# EasyEDA Pro project URADORRY-SUN.eprj, board Sub - ATmega32U4/Rev1.0
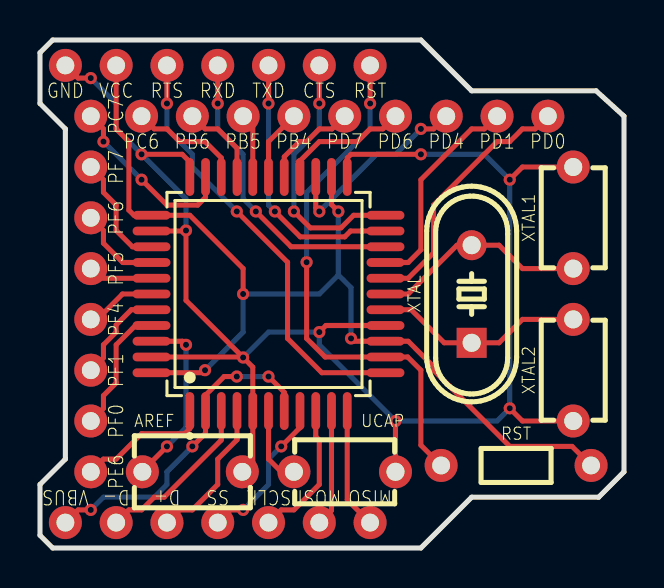
[diagram p2: board, top side]
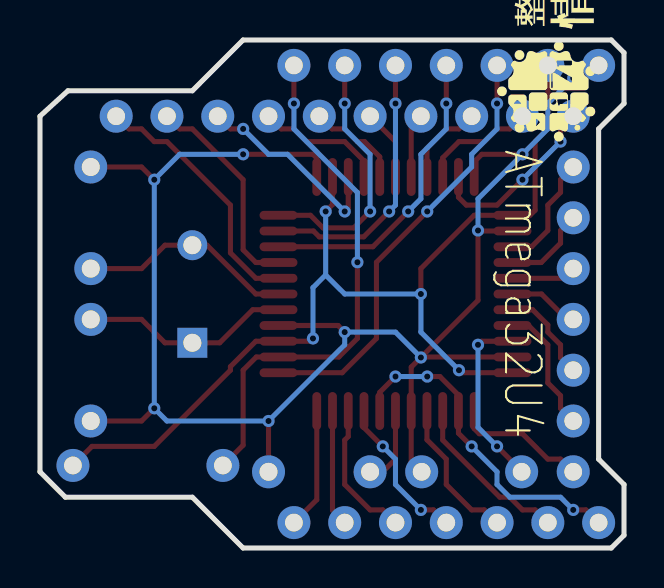
[diagram p3: board, bottom side, seen from below]

Outline 29.21 x 25.4 mm; copper layers: Top Layer, Bottom Layer. Coordinates in mm from the lower left corner of the outline.
Outline path: 0,24.77 0.64,25.4 19.05,25.4 21.59,22.86 27.81,22.86 29.21,21.59 29.21,3.81 27.94,2.54 21.59,2.54 19.05,0 0.64,0 0,0.64 0,3.17 1.27,4.45 1.27,20.95 0,22.23 0,24.77
Stack: Top Layer 0.035mm / Dielectric1 1.51mm FR4 er 4.5 / Bottom Layer 0.035mm

## Design rules (mm)
template: JLCPCB Capability(Two Layers Board)
spacing copperThickness1oz (default): track to track 0.102, other pairs 0.152 to 0.3
spacing copperThickness2oz: track to track 0.203, other pairs 0.152 to 0.3
track width copperThickness1oz (default): min 0.127, default 0.254, max 2.54
track width copperThickness2oz: min 0.203, default 0.254, max 2.54
differential pair differentialPair (default): width min 0.127, default 0.254, max 2.54; gap min 0.152, default 0.152
via viaSize (default): diameter min 0.5, default 0.61, max 10; hole min 0.3, default 0.305, max 6.3

## Placement (name value [footprint] x y rotation side)
AREF  100nF  [cap-th_l5.8-w3.6-p5.0-d0.6]  7.62 3.81 180 top
ATmega32U4  ATMEGA32U4-AU  [QFP-44_L10.0-W10.0-P0.80-LS13.2-BL]  11.43 12.7 0 top
NOREF  -  [Pad_e41]  6.35 24.13 0 top
NOREF#2  -  [Pad_e40]  13.97 24.13 0 top
NOREF#3  -  [Pad_e28]  1.27 24.13 0 top
NOREF#4  -  [Pad_e47]  7.62 21.59 0 top
NOREF#5  -  [Pad_e45]  2.54 21.59 0 top
NOREF#6  -  [Pad_e53]  2.54 19.05 0 top
NOREF#7  -  [Pad_e54]  2.54 16.51 0 top
NOREF#8  -  [Pad_e46]  5.08 21.59 0 top
NOREF#9  -  [Pad_e49]  12.7 21.59 0 top
NOREF#10  -  [Pad_e56]  2.54 8.89 0 top
NOREF#11  -  [Pad_e32]  6.35 1.27 0 top
NOREF#12  -  [Pad_e30]  1.27 1.27 0 top
NOREF#13  -  [Pad_e33]  8.89 1.27 0 top
NOREF#14  -  [Pad_e51]  17.78 21.59 0 top
NOREF#15  -  [Pad_e57]  2.54 11.43 0 top
NOREF#16  -  [Pad_e44]  25.4 21.59 0 top
NOREF#17  -  [Pad_e36]  16.51 1.27 0 top
NOREF#18  -  [Pad_e31]  3.81 1.27 0 top
NOREF#19  -  [Pad_e55]  2.54 13.97 0 top
NOREF#20  -  [Pad_e34]  11.43 1.27 0 top
NOREF#21  -  [Pad_e35]  13.97 1.27 0 top
NOREF#22  -  [Pad_e29]  3.81 24.13 0 top
NOREF#23  -  [Pad_e50]  15.24 21.59 0 top
NOREF#24  -  [Pad_e38]  11.43 24.13 0 top
NOREF#25  -  [Pad_e52]  20.32 21.59 0 top
NOREF#26  -  [Pad_e37]  16.51 24.13 0 top
NOREF#27  -  [Pad_e58]  2.54 6.35 0 top
NOREF#28  -  [Pad_e42]  2.54 3.81 0 top
NOREF#29  -  [Pad_e48]  10.16 21.59 0 top
NOREF#30  -  [Pad_e43]  22.86 21.59 0 top
NOREF#31  -  [Pad_e39]  8.89 24.13 0 top
RST  10kΩ  [res-th_bd1.7-l3.5-p7.50-d0.5]  23.81 4.13 180 top
UCAP  1uF  [cap-th_l5.0-w3.2-p5.08-d0.6]  15.24 3.81 180 top
XTAL  16MHz  [HC-49US_L11.5-W4.5-P4.88]  21.59 12.7 90 top
XTAL1  20pF  [cap-th_l5.0-w3.2-p5.08-d0.6]  26.67 16.51 270 top
XTAL2  20pF  [cap-th_l5.0-w3.2-p5.08-d0.6]  26.67 8.89 90 top

## Footprints (pads in the part's own frame, mm; a bottom-side part is the same pattern mirrored in y, then rotated)
cap-th_l5.0-w3.2-p5.08-d0.6
  round 1.651 hole 0.9x0.889: 1(-2.54,0) 2(2.54,0)
cap-th_l5.8-w3.6-p5.0-d0.6
  round 1.651 hole 0.889: 1(-2.5,0) 2(2.5,0)
HC-49US_L11.5-W4.5-P4.88
  rect 1.5x1.5 hole 0.9: 1(-2.44,0)
  round 1.5 hole 0.9: 2(2.44,0)
Pad_e28
  round 1.651 hole 0.889: 1(0,0)
Pad_e29
  round 1.651 hole 0.889: 1(0,0)
Pad_e30
  round 1.651 hole 0.889: 1(0,0)
Pad_e31
  round 1.651 hole 0.889: 1(0,0)
Pad_e32
  round 1.651 hole 0.889: 1(0,0)
Pad_e33
  round 1.651 hole 0.889: 1(0,0)
Pad_e34
  round 1.651 hole 0.889: 1(0,0)
Pad_e35
  round 1.651 hole 0.889: 1(0,0)
Pad_e36
  round 1.651 hole 0.889: 1(0,0)
Pad_e37
  round 1.651 hole 0.889: 1(0,0)
Pad_e38
  round 1.651 hole 0.889: 1(0,0)
Pad_e39
  round 1.651 hole 0.889: 1(0,0)
Pad_e40
  round 1.651 hole 0.889: 1(0,0)
Pad_e41
  round 1.651 hole 0.889: 1(0,0)
Pad_e42
  round 1.651 hole 0.889: 1(0,0)
Pad_e43
  round 1.651 hole 0.889: 1(0,0)
Pad_e44
  round 1.651 hole 0.889: 1(0,0)
Pad_e45
  round 1.651 hole 0.889: 1(0,0)
Pad_e46
  round 1.651 hole 0.889: 1(0,0)
Pad_e47
  round 1.651 hole 0.889: 1(0,0)
Pad_e48
  round 1.651 hole 0.889: 1(0,0)
Pad_e49
  round 1.651 hole 0.889: 1(0,0)
Pad_e50
  round 1.651 hole 0.889: 1(0,0)
Pad_e51
  round 1.651 hole 0.889: 1(0,0)
Pad_e52
  round 1.651 hole 0.889: 1(0,0)
Pad_e53
  round 1.651 hole 0.889: 1(0,0)
Pad_e54
  round 1.651 hole 0.889: 1(0,0)
Pad_e55
  round 1.651 hole 0.889: 1(0,0)
Pad_e56
  round 1.651 hole 0.889: 1(0,0)
Pad_e57
  round 1.651 hole 0.889: 1(0,0)
Pad_e58
  round 1.651 hole 0.889: 1(0,0)
QFP-44_L10.0-W10.0-P0.80-LS13.2-BL
  oval 0.441x1.895 smd: 1(-3.937,-5.851) 2(-3.15,-5.851) 3(-2.362,-5.851) 4(-1.575,-5.851) 5(-0.787,-5.851) 6(0,-5.851) 7(0.787,-5.851) 8(1.575,-5.851) 9(2.362,-5.851) 10(3.15,-5.851) 11(3.937,-5.851) 23(3.937,5.851) 24(3.15,5.851) 25(2.362,5.851) 26(1.575,5.851) 27(0.787,5.851) 28(0,5.851) 29(-0.787,5.851) 30(-1.575,5.851) 31(-2.362,5.851) 32(-3.15,5.851) 33(-3.937,5.851)
  oval 1.895x0.441 smd: 12(5.851,-3.937) 13(5.851,-3.15) 14(5.851,-2.362) 15(5.851,-1.575) 16(5.851,-0.787) 17(5.851,0) 18(5.851,0.787) 19(5.851,1.575) 20(5.851,2.362) 21(5.851,3.15) 22(5.851,3.937) 34(-5.851,3.937) 35(-5.851,3.15) 36(-5.851,2.362) 37(-5.851,1.575) 38(-5.851,0.787) 39(-5.851,0) 40(-5.851,-0.787) 41(-5.851,-1.575) 42(-5.851,-2.362) 43(-5.851,-3.15) 44(-5.851,-3.937)
res-th_bd1.7-l3.5-p7.50-d0.5
  round 1.651 hole 0.889: 1(-3.75,0) 2(3.75,0)

## Nets
+3.3V: ATmega32U4.14 ATmega32U4.24 ATmega32U4.34 ATmega32U4.44 NOREF#22.1 RST.1
+5V: ATmega32U4.2 ATmega32U4.7 NOREF#12.1
GND: AREF.1 ATmega32U4.5 ATmega32U4.15 ATmega32U4.23 ATmega32U4.33 ATmega32U4.35 ATmega32U4.43 NOREF#3.1 UCAP.1 XTAL1.1 XTAL2.1
AREF: AREF.2 ATmega32U4.42
CTS/AT: ATmega32U4.22 NOREF#2.1
D+/AT: ATmega32U4.4 NOREF#11.1
D-/AT: ATmega32U4.3 NOREF#18.1
MISO/AT: ATmega32U4.11 NOREF#17.1
MOSI/AT: ATmega32U4.10 NOREF#21.1
PB4: ATmega32U4.28 NOREF#9.1
PB5: ATmega32U4.29 NOREF#29.1
PB6: ATmega32U4.30 NOREF#4.1
PC6: ATmega32U4.31 NOREF#8.1
PC7: ATmega32U4.32 NOREF#5.1
PD0: ATmega32U4.18 NOREF#16.1
PD1: ATmega32U4.19 NOREF#30.1
PD4: ATmega32U4.25 NOREF#25.1
PD6: ATmega32U4.26 NOREF#14.1
PD7: ATmega32U4.27 NOREF#23.1
PE6: ATmega32U4.1 NOREF#28.1
PF0: ATmega32U4.41 NOREF#27.1
PF1: ATmega32U4.40 NOREF#10.1
PF4: ATmega32U4.39 NOREF#15.1
PF5: ATmega32U4.38 NOREF#19.1
PF6: ATmega32U4.37 NOREF#7.1
PF7: ATmega32U4.36 NOREF#6.1
RST: ATmega32U4.13 NOREF#26.1 RST.2
RTS/AT: ATmega32U4.12 NOREF.1
RXD/AT: ATmega32U4.20 NOREF#31.1
SCLK/AT: ATmega32U4.9 NOREF#20.1
SS/AT: ATmega32U4.8 NOREF#13.1
TXD/AT: ATmega32U4.21 NOREF#24.1
UCAP: ATmega32U4.6 UCAP.2
XTAL1: ATmega32U4.17 XTAL.2 XTAL1.2
XTAL2: ATmega32U4.16 XTAL.1 XTAL2.2

## Via types
v1: diameter 0.61, hole 0.305, Top Layer to Bottom Layer, 35 vias

## Routing (per net, layer and track width the routed paths; a pad name or vN(x,y) marks a point on that pad's centre or on a via; arc(x,y) is an arc through that point)
+3.3V: length 51.4
  Top Layer w0.254: v1(15.56,10.48) 15.7,10.34 ATmega32U4.14 18.42,10.34 19.69,9.07 19.69,8.89 23.5,5.08 26.61,5.08 RST.1 ; ATmega32U4.44 8.13,8.76 v1(8.25,8.89) ; v1(14.92,16.83) 14.58,17.17 ATmega32U4.24 ; NOREF#22.1 3.81,20.95 4.44,20.32 4.44,16.89 4.7,16.64 ATmega32U4.34 7.49,16.64 10.16,13.97 v1(10.16,12.7)
  Bottom Layer w0.254: 14.92,13.65 15.56,13.02 v1(15.56,10.48) ; 14.92,13.65 v1(14.92,16.83) ; 14.92,13.65 13.97,12.7 v1(10.16,12.7) 10.16,10.8 v1(8.25,8.89)
+5V: length 16.7
  Top Layer w0.254: v1(2.54,1.91) 1.91,1.91 NOREF#12.1 ; v1(7.62,5.08) 8.28,5.74 ATmega32U4.2 8.28,7.65 9.21,8.57 v1(9.84,8.57) ; v1(11.43,8.57) 12.22,7.78 ATmega32U4.7
  Bottom Layer w0.254: v1(9.84,8.57) v1(11.43,8.57) ; v1(2.54,1.91) 3.18,2.54 5.72,2.54 6.35,3.17 6.35,3.81 v1(7.62,5.08)
GND: length 84.7
  Top Layer w0.254: v1(23.5,18.42) 24.13,19.05 XTAL1.1 ; 10.13,9.55 v1(10.16,9.53) 10.64,9.04 ATmega32U4.5 10.64,4.29 10.16,3.81 AREF.1 ; 10.13,9.55 ATmega32U4.43 ; 10.13,9.55 7.3,12.38 v1(7.3,15.88) 7.28,15.85 ATmega32U4.35 ; UCAP.1 v1(17.78,6.35) ; v1(23.5,6.98) 24.13,6.35 XTAL2.1 ; v1(2.54,23.5) 1.91,23.5 NOREF#3.1 ; v1(13.97,10.8) 14.3,11.12 ATmega32U4.15 ; ATmega32U4.33 7.49,19.3 7.11,19.69 v1(5.08,19.69) ; ATmega32U4.23 15.37,19.49 15.56,19.69 v1(19.05,19.69)
  Bottom Layer w0.254: v1(7.3,15.88) 7.3,17.46 v1(5.08,19.69) 3.81,20.95 3.81,22.23 v1(2.54,23.5) ; v1(10.16,9.53) 11.43,10.8 v1(13.97,10.8) 13.97,10.16 v1(17.78,6.35) 22.86,6.35 v1(23.5,6.98) v1(23.5,18.42) 22.22,19.69 v1(19.05,19.69)
AREF: length 9.1
  Top Layer w0.254: ATmega32U4.42 7.12,10.34 v1(7.3,10.16) ; AREF.2 5.12,3.85 v1(6.35,5.08)
  Bottom Layer w0.254: v1(6.35,5.08) 7.3,6.03 v1(7.3,10.16)
CTS/AT: length 13
  Top Layer w0.254: ATmega32U4.22 15.68,16.64 15.05,16.01 13.52,16.01 v1(12.7,16.83) ; v1(13.97,22.23) NOREF#2.1
  Bottom Layer w0.254: v1(12.7,16.83) 12.7,19.69 13.97,20.95 v1(13.97,22.23)
D+/AT: length 7.4
  Top Layer w0.254: NOREF#11.1 6.99,1.91 7.62,1.91 8.89,3.17 8.89,4.45 9.86,5.41 ATmega32U4.4
D-/AT: length 8.4
  Top Layer w0.254: NOREF#18.1 4.44,1.91 5.08,1.91 5.72,2.54 6.21,2.54 9.07,5.4 ATmega32U4.3
MISO/AT: length 6.1
  Top Layer w0.254: NOREF#17.1 15.37,2.41 ATmega32U4.11
MOSI/AT: length 5.8
  Top Layer w0.254: ATmega32U4.10 14.58,1.88 NOREF#21.1
PB4: length 3.6
  Top Layer w0.254: ATmega32U4.28 11.43,20.32 NOREF#9.1
PB5: length 3.2
  Top Layer w0.254: NOREF#29.1 10.64,21.11 ATmega32U4.29
PB6: length 4.3
  Top Layer w0.254: ATmega32U4.30 9.86,19.99 8.89,20.95 8.25,20.95 NOREF#4.1
PC6: length 5.8
  Top Layer w0.254: ATmega32U4.31 9.07,19.51 8.25,20.32 6.99,20.32 6.35,20.95 5.72,20.95 NOREF#8.1
PC7: length 9.1
  Top Layer w0.254: ATmega32U4.32 8.28,17.54 7.89,17.14 6.35,17.14 v1(5.08,18.42) ; v1(3.18,20.32) 3.18,20.95 NOREF#5.1
  Bottom Layer w0.254: v1(3.18,20.32) v1(5.08,18.42)
PD0: length 12.9
  Top Layer w0.254: ATmega32U4.18 18.42,13.49 19.69,14.76 19.69,17.14 22.86,20.32 23.5,20.32 24.13,20.95 24.77,20.95 NOREF#16.1 25.38,21.59
PD1: length 10.7
  Top Layer w0.254: ATmega32U4.19 18.42,14.28 19.05,14.91 19.05,18.42 21.59,20.95 22.22,20.95 NOREF#30.1
PD4: length 10.1
  Top Layer w0.254: v1(13.97,16.83) 13.79,17.01 ATmega32U4.25 ; NOREF#25.1 19.69,20.95 v1(19.05,20.95)
  Bottom Layer w0.254: v1(19.05,20.95) 17.78,19.69 16.83,19.69 v1(13.97,16.83)
PD6: length 6.5
  Top Layer w0.254: NOREF#14.1 17.15,20.95 16.51,20.95 15.88,20.32 13.97,20.32 13,19.36 ATmega32U4.26
PD7: length 4.9
  Top Layer w0.254: NOREF#23.1 14.61,20.95 13.97,20.95 13.34,20.32 12.98,20.32 12.22,19.56 ATmega32U4.27
PE6: length 6.7
  Top Layer w0.254: ATmega32U4.1 7.49,5.97 7.24,5.72 5.08,5.72 3.81,4.45 3.18,4.45 NOREF#28.1
PF0: length 6.5
  Top Layer w0.254: NOREF#27.1 3.18,6.98 3.18,7.62 3.81,8.26 3.81,10.16 4.78,11.12 ATmega32U4.41
PF1: length 4.9
  Top Layer w0.254: NOREF#10.1 2.56,8.89 3.18,9.51 3.18,10.16 3.81,10.8 3.81,11.15 4.57,11.91 ATmega32U4.40
PF4: length 3.6
  Top Layer w0.254: NOREF#15.1 2.86,11.43 4.13,12.7 ATmega32U4.39
PF5: length 3.2
  Top Layer w0.254: NOREF#19.1 3.02,13.49 ATmega32U4.38
PF6: length 4.3
  Top Layer w0.254: ATmega32U4.37 4.14,14.28 3.18,15.24 3.18,15.88 NOREF#7.1
PF7: length 5.8
  Top Layer w0.254: NOREF#6.1 3.18,18.42 3.18,17.78 3.81,17.14 3.81,15.88 4.62,15.06 ATmega32U4.36
RST: length 26.5
  Top Layer w0.254: v1(16.51,22.23) NOREF#26.1 ; v1(13.34,14.29) 13.34,10.48 14.26,9.55 ATmega32U4.13 18.39,9.55 19.05,8.89 19.05,5.14 RST.2
  Bottom Layer w0.254: v1(13.34,14.29) 13.34,17.78 16.51,20.95 v1(16.51,22.23)
RTS/AT: length 21.8
  Top Layer w0.254: ATmega32U4.12 14.1,8.76 12.38,10.48 12.38,14.29 v1(9.84,16.83) ; v1(6.35,22.23) NOREF.1
  Bottom Layer w0.254: v1(6.35,22.23) 6.35,20.95 7.62,19.69 7.62,19.05 v1(9.84,16.83)
RXD/AT: length 15.3
  Top Layer w0.254: v1(10.8,16.83) 12.56,15.06 ATmega32U4.20 ; v1(8.89,22.23) NOREF#31.1
  Bottom Layer w0.254: v1(8.89,22.23) 8.89,20.95 10.16,19.69 10.16,17.46 v1(10.8,16.83)
SCLK/AT: length 7.1
  Top Layer w0.254: ATmega32U4.9 13.79,5.58 13.97,5.4 13.97,3.17 12.7,1.91 12.06,1.91 NOREF#20.1
SS/AT: length 7.7
  Top Layer w0.254: v1(10.16,1.91) 9.53,1.91 NOREF#13.1 ; ATmega32U4.8 13,6.02 v1(12.06,5.08)
  Bottom Layer w0.254: v1(12.06,5.08) 11.43,4.45 11.43,3.17 v1(10.16,1.91)
TXD/AT: length 13.6
  Top Layer w0.254: v1(11.75,16.83) 13.02,15.56 15.24,15.56 15.53,15.85 ATmega32U4.21 ; v1(11.43,22.23) NOREF#24.1
  Bottom Layer w0.254: v1(11.75,16.83) 11.43,17.14 v1(11.43,22.23)
UCAP: length 3.9
  Top Layer w0.254: ATmega32U4.6 11.43,4.45 12.06,3.81 UCAP.2
XTAL1: length 10.9
  Top Layer w0.254: ATmega32U4.17 18.42,12.7 20.86,15.14 XTAL.2 22.96,15.14 24.13,13.97 XTAL1.2
XTAL2: length 10.6
  Top Layer w0.254: ATmega32U4.16 18.57,11.91 20.22,10.26 XTAL.1 22.96,10.26 24.13,11.43 XTAL2.2

## Text on the board
Bottom Silkscreen Layer: ATmega32U4
Top Silkscreen Layer: GND | VCC | PC6 | RTS | PB6 | RXD | PB5 | TXD | PB4 | CTS | PD7 | RST | PD6 | PD4 | PD1 | PD0 | PC7 | PF7 | PF6 | PF5 | PF4 | PF1 | PF0 | PE6 | VBUS | D- | D+ | SS | SCLK | MOSI | MISO
